# EAGLE board Dragino Pan.v2.0.1 (EAGLE 7.5.0) (continued)
## Tracks (layer width: path | path; a pad name or v marks a point on that pad's centre or on a via) (continued)
  pour Top (rank 2): 18.36,26.55 23.83,30.23 30.23,30.31 30.23,52.79 56.39,52.92 56.39,14.5 70.61,14.5 70.61,110.83 44.2,110.83 44.2,121.24 35.81,121.24 35.81,152.99 53.09,152.99 53.09,159.09 -0.76,159.09 -0.38,26.63
  pour Bottom (rank 2): -0.38,26.63 18.36,26.55 23.83,30.23 30.23,30.31 30.23,52.79 56.39,52.92 56.39,14.5 70.61,14.5 70.61,110.83 44.2,110.83 44.2,121.24 35.81,121.24 35.81,152.99 53.09,152.99 53.09,159.09 -0.76,159.09
  pour Top (isolate 0.406, no thermals): 6.1,35.01 18.8,35.01 18.8,30.69 12.32,30.69 12.32,32.34 6.22,32.34
  pour Top (isolate 0.254, no thermals): 63.63,25.23 69.6,25.23 69.6,20.66 63.88,20.66 63.88,21.67 58.67,21.67 58.67,24.47 63.63,24.47
GPIO1  (via drill 0.3)
  Top 0.254: R28.1 58.17,39.28 58.17,57.23 v56.39,59.01 | v24.51,97.75 24.51,99.11 U5.38
  Bottom 0.254: v56.39,59.01 47.12,68.28 39.5,68.28 39.12,68.66 39.12,69.43 39.37,69.68 39.37,70.44 34.54,75.27 34.04,75.27 26.03,83.27 26.03,86.06 26.54,86.57 26.54,95.72 v24.51,97.75
GPIO6  (via drill 0.3)
  Top 0.203: v28.32,82.38 28.32,81.24 29.97,79.59 36.07,79.59 37.34,78.32 42.8,78.32 43.94,77.17 43.94,75.68 U5.1
  Bottom 0.203: R36.2 27.94,108.67 28.57,108.03 28.57,82.63 v28.32,82.38
GPIO7  (via drill 0.3)
  Top 0.203: v29.08,81.62 29.08,81.11 30.23,79.97 36.32,79.97 37.59,78.7 45.42,78.7 U5.58
  Bottom 0.203: v29.08,81.62 29.08,109.18 28.57,109.69 R37.2
GPIO8  (via drill 0.3)
  Top 0.203: U5.3 40.29,76.25 38.61,77.94 37.08,77.94 35.81,79.2 29.72,79.2 27.94,80.98 27.94,81.62 27.56,82 27.56,83.14 v27.69,83.27
  Bottom 0.203: R10.2 27.81,107.65 28.07,107.4 28.07,83.65 v27.69,83.27
GPIO14  (via drill 0.3)
  Top 0.203: U5.40 28.29,102.61 27.18,103.72 23.24,103.72 v22.73,103.21
  Bottom 0.203: v22.73,103.21 R35.2
GPIO15  (via drill 0.3)
  Top 0.203: U5.41 30.29,103.02 29.21,104.1 22.86,104.1 v22.73,104.22
  Bottom 0.203: v22.73,104.22 R34.2
GPIO16  (via drill 0.3)
  Top 0.203: U5.42 32.29,103.18 30.48,104.99 22.99,104.99 v22.73,105.24
  Bottom 0.203: v22.73,105.24 R39.1
GPIO18  (via drill 0.3)
  Top 0.203: v5.46,86.19 6.65,86.19 U5.24
  Top 0.254: ROUTER.10 15.34,64.12 12.83,66.63 11.43,66.63 10.54,65.74 8.76,65.74 v7.24,67.27
  Bottom 0.254: v7.24,67.27 7.24,68.28 6.22,69.3 6.22,79.2 5.97,79.46 5.59,79.46 5.21,79.84 5.21,80.86 5.71,81.36 5.71,85.94 v5.46,86.19
GPIO19  (via drill 0.3)
  Top 0.203: v6.22,92.29 6.74,92.29 U5.27
  Bottom 0.254: ROUTER.6 10.26,67.55 7.75,70.06 7.75,81.62 6.73,82.63 6.73,91.78 v6.22,92.29
GPIO20  (via drill 0.3, 0.33)
  Top 0.203: v5.97,88.35 6.77,88.35 U5.25
  Top 0.254: v2.92,155.41 2.41,154.9 2.41,154.13 1.27,152.99 1.27,106.76 3.56,104.48 v3.56,104.22
  Bottom 0.254: v2.92,155.41 2.92,154.52 9.4,148.04 9.4,137.5 11.18,135.72 12.53,135.72 BEE-CON-1.5 | v3.56,104.22 3.56,90.76 v5.97,88.35 6.22,88.09 6.22,82.38 7.24,81.36 7.24,69.81 9.78,67.27 9.78,64.98 9.02,64.22 9.02,62.16 ROUTER.5
GPIO21  (via drill 0.3)
  Top 0.203: v8.25,94.19 6.93,94.19 U5.28
  Bottom 0.254: ROUTER.8 12.8,65.52 12.06,66.25 12.06,68.03 9.27,70.82 9.27,93.17 v8.25,94.19
GPIO22  (via drill 0.3)
  Top 0.203: v7.75,84.28 6.84,84.28 U5.23
  Bottom 0.254: ROUTER.7 12.7,60.92 11.43,62.19 11.43,64.6 10.79,65.23 10.79,67.78 8.25,70.31 8.25,82 7.37,82.89 7.37,83.9 v7.75,84.28
GPIO23  (via drill 0.3)
  Top 0.203: U5.26 7.67,90.33 v7.75,90.25
  Top 0.254: ROUTER.9 15.34,60.95 14.1,62.19 14.1,64.6 13.08,65.62 v11.56,65.62
  Bottom 0.254: v11.56,65.62 11.56,67.78 8.76,70.57 8.76,84.54 8.13,85.17 7.62,85.17 7.24,85.56 7.24,89.75 v7.75,90.25
GPIO24  (via drill 0.3)
  Top 0.203: v5.97,80.35 6.77,80.35 U5.21
  Top 0.254: ROUTER.12 17.88,64.12 14.6,67.39 v8.38,67.39
  Bottom 0.254: v8.38,67.39 8.38,67.9 6.73,69.55 6.73,79.59 v5.97,80.35
GPIO26  (via drill 0.3)
  Top 0.254: U5.5 36.29,77.33 35.31,78.32 29.21,78.32 27.05,80.47 27.05,81.11 26.42,81.75 26.42,85.05 v26.8,85.43
  Bottom 0.254: v26.8,85.43 26.92,85.43 27.05,85.56 27.05,105.19 26.62,105.62 R40.1
GPIO27  (via drill 0.3)
  Top 0.203: v27.18,84.41 27.18,84.03 26.92,83.78 26.92,82 27.56,81.36 27.56,80.73 29.46,78.82 35.56,78.82 36.83,77.55 37.72,77.55 38.35,76.92 38.35,75.4 U5.4 | v27.05,106.51 23.88,109.69 v23.88,116.67 | v12.32,116.8 12.37,116.85 R30.2
  Bottom 0.203: v27.18,84.41 27.56,84.79 27.56,106 v27.05,106.51 26.92,106.64 R11.1 | v23.88,116.67 23.75,116.8 v12.32,116.8
JUMPSTART  (via drill 0.3)
  Top 0.203: v48.77,77.17 48.77,78.19 47.24,79.71 46.41,79.71 U5.57
  Top 0.254: v49.4,10.62 49.38,10.64 C14.1 49.53,12.35 49.53,13.04 51.18,14.69 51.18,14.82 56.64,20.28 56.64,36.15 57.66,37.17 57.66,47.51 | U5.57 45.61,80.33 | v56.13,60.41 55.63,59.9 55.63,58.5 56.13,58 56.64,58 57.66,56.98 57.66,47.51 | R42.2 57.66,47.51
  Bottom 0.254: SW1.1 49.76,10.27 v49.4,10.62 | v48.77,77.17 49.02,76.92 49.02,67.14 55.75,60.41 v56.13,60.41
LAN_LED  (via drill 0.3)
  Top 0.254: R19.1 34.53,153.12 4.44,153.12 2.79,151.47 2.79,108.03 4.83,106 v14.22,106 | v26.29,100.16 U5.39
  Bottom 0.254: v26.29,100.16 23.24,100.16 22.61,100.8 22.61,101.18 21.84,101.94 20.95,101.94 17.91,104.99 15.87,104.99 14.86,106 v14.22,106
LED_SYS  (via drill 0.3)
  Top 0.254: SYS.A 29.04,158.58 8.38,158.58 1.78,151.98 1.78,107.53 4.32,104.99 13.08,104.99 14.1,103.97 v14.22,103.97 | v19.18,101.56 19.3,101.43 19.3,97.62 19.94,96.98 35.43,96.98 36.07,97.62 36.07,99.11 U5.44
  Bottom 0.254: v14.22,103.97 17.4,103.97 19.18,102.19 v19.18,101.56
N$1  (via drill 0.3)
  Top 0.203: C1.1 R2.1 47.08,57.74 v47.08,58.7 | v45.16,58.7 45.16,57.78 R1.1
  Bottom 0.203: v45.16,58.7 v47.08,58.7
N$2
  Top 0.254: U2.1 10.54,39.33 L6.P$1 C17.2
  pour Top (isolate 0.254, no thermals): 10.16,35.77 11.43,35.77 11.43,41.1 10.16,41.1
N$3  (via drill 0.3)
  Top 0.203: C2.1 R4.1 v53.05,58.7 | R3.1 50.91,57.78 v50.91,58.7
  Bottom 0.203: v50.91,58.7 v53.05,58.7
N$4  (via drill 0.3)
  Top 0.203: C3.1 R5.1 35.26,58.43 v35.05,58.63 | v36.96,58.63 36.96,57.86 R6.1
  Bottom 0.203: v35.05,58.63 v36.96,58.63
N$5  (via drill 0.3)
  Top 0.203: v42.92,58.7 42.95,58.7 R8.1 | v41.16,58.7 41.16,57.8 R7.1 C4.1
  Bottom 0.203: v41.16,58.7 v42.92,58.7
N$6
  Top 0.203: R14.2 48.69,156.58 PWR.K
N$7
  Bottom 0.254: 39.81,82.89 38.73,82.89 37.85,82 37.85,78.32 37.08,77.55 R23.1
  Bottom 0.305: U3.41 39.81,82.89
N$8
  Bottom 0.305: U3.27 45.82,77 C20.1
N$9
  Top 0.254: R18.2 C57.1
N$10
  Top 0.254: T1.18 49.08,46.26 49.53,45.8 50.16,45.8 50.42,45.55 R9.2
N$11
  Bottom 0.203: R35.1 20.57,103.21 18.29,105.49 16.13,105.49 14.22,107.4 12.45,107.4 11.94,107.91 10.03,107.91 9.02,108.92 6.48,108.92 5.33,110.07 5.33,112.35 ROUTER2.2
N$12
  Top 0.406: C7.1 R9.1
N$13
  Top 0.61: U2.6 8,29.78 8.25,29.52 C57.2
N$14
  Top 0.254: U4.5 58.93,17.48
  Top 0.61: R55.1 58.93,17.48 R56.2
N$15  (via drill 0.3)
  Top 0.254: U4.3 R57.1 59.51,27.95 59.13,28.33 v59.13,31 | v59.13,40.85 Q1.1
  Bottom 0.254: v59.13,31 v59.13,40.85
N$16
  Bottom 0.254: R21.2 36.58,80.6 36.83,80.86 36.83,82.63 38.1,83.9 U3.43
N$17
  Top 0.254: T1.13 39.08,46.48 39.75,45.8 40.39,45.8 40.64,45.55 40.64,44.88 R12.2
N$18
  Top 0.406: C10.1 R12.1
N$19
  Top 0.254: U4.7 R22.1
N$20
  Top 0.254: Q1.3 60.64,37.66 R24.2 60.96,37.35 R28.2
N$21
  Top 0.254: U4.6 C58.2
N$22  (via drill 0.3)
  Top 0.254: U14.5 59.56,76.79 53.47,70.7 43.43,70.7 v42.54,71.59
  Bottom 0.254: R20.2 42.29,74.81 C15.1 42.29,74.71 42.29,74 42.54,73.74 v42.54,71.59
N$23
  Top 0.254: R19.2 38.99,156.58 LAN.K
N$24
  Bottom 0.305: R27.2 46.66,89.03 46.32,88.69 U3.11
N$25
  Top 0.254: R46.2 U2.3
N$26
  Top 0.254: U2.7 R17.1
N$27
  Top 0.254: C17.1 U2.2
N$28
  Top 0.61: C58.1 60.2,16.01 R29.1
N$29
  Bottom 0.305: U3.9 45.32,89.6 46.74,91.02 47.12,91.02 47.37,91.27 R15.2 C16.1
N$30
  Bottom 0.254: U3.7 44.32,90 45.34,91.02
  Bottom 0.305: 45.46,91.71 R16.2 45.34,91.02
N$31
  Top 0.254: WLAN.K 18.47,156.71 R31.2
N$32
  Top 0.254: R32.2 28.5,156.58 SYS.K
N$33
  Bottom 0.203: R39.2 19.81,105.24 18.8,106.26 16.64,106.26 14.6,108.29 12.83,108.29 11.81,109.3 8.07,109.3 ROUTER2.1
N$34
  Top 0.254: C41.2 61.47,30.95 61.59,31.07 62.61,31.07 62.74,31.2
  Top 0.406: U4.1 62.74,31.2 62.74,32.43 L2.P$1
  pour Top (isolate 0.254, no thermals): 62.48,25.1 63.12,25.1 63.12,28.79 63.12,29.17 63.88,29.17 63.88,35.52 61.72,35.52 61.72,29.55 62.48,29.55
N$35
  Bottom 0.203: ROUTER2.5 13.15,109.3 14.86,109.3 17.02,107.14 24.13,107.14 24.64,106.64 R11.2
N$36
  Top 0.254: T4.2 R30.1
N$39
  Bottom 0.203: R10.1 17.27,107.65 15.24,109.69 13.46,109.69 12.83,110.32 12.83,112.16 ROUTER2.6
N$43
  Bottom 0.203: ROUTER2.3 10.22,109.69 12.06,109.69 12.95,108.8 14.73,108.8 16.76,106.76 23.88,106.76 24.26,106.38 24.26,105.88 24.51,105.62 R40.2
N$49
  Top 0.406: R13.1 6.63,30.74 U2.5
  Top 0.61: R41.2 R13.1
N$50  (via drill 0.3)
  Top 0.203: v10.29,108.67 10.29,112.16 ROUTER2.4
  Bottom 0.203: R34.1 20.19,104.22 18.54,105.88 16.38,105.88 14.48,107.78 12.7,107.78 11.68,108.8 10.41,108.8 v10.29,108.67
N$53
  Top 0.305: D25.C 9.5,24.59 9.93,25.03 12.22,25.03 12.65,24.59 12.65,24.67 L3.P$2
  Top 0.813: 12.32,24.59 L3.P$2
  Top 1.422: L3.P$2 17.4,25 17.4,22.31 19.81,22.31 F2.P$1
N$54
  Bottom 0.203: R36.1 16.89,108.67 15.37,110.19 15.37,112.16 ROUTER2.8
N$55
  Top 0.254: U4.2 C41.1
N$56
  Bottom 0.203: R37.1 18.67,109.69 17.91,110.45 17.91,112.16 ROUTER2.10
P0_R_N
  Top 0.203: X11.2-3 32.61,15.2 32.36,15.45 32.36,16.12 32.99,16.75 39.85,16.75 42.27,19.17 42.27,28.56 44.42,30.72 47.12,30.72 | 47.12,30.72 49.75,30.72 50.9,31.87 50.9,37.64 50.13,38.41 47.08,38.41 46.33,39.17 46.33,46.2 T1.17 | 47.12,30.72 47.12,30.07 P1.3
P0_R_P
  Top 0.203: 50.44,36.91 50.44,37.45 49.94,37.95 46.89,37.95 45.87,38.98 45.87,46.16 T1.16 | 50.44,36.91 50.44,32.06 49.56,31.17 44.23,31.17 41.81,28.75 41.81,19.36 39.66,17.2 32.8,17.2 31.9,16.31 31.9,14.21 31.62,13.93 29.72,13.93 29.46,13.67 X11.2-6 | P1.1 50.37,36.84 50.44,36.91
P0_RX_N
  Top 0.203: T1.4 47.08,54.81 46.3,55.58 46.3,56.73 | 46.3,56.73 46.3,60.28 | 46.3,60.28 46.3,61.89 45.04,63.15 43.65,63.15 40.47,66.33 30.06,66.33 23.45,72.93 20.02,72.93 19.38,73.58 19.38,74.42 U5.13 | R2.2 46.32,56.74 46.3,56.73 | D22.P$2 46.35,60.33 46.3,60.28
P0_RX_P
  Top 0.203: T1.5 45.08,54.77 45.9,55.58 45.9,56.73 | 45.9,56.73 45.9,60.41 | 45.9,60.41 45.9,61.72 44.87,62.75 43.48,62.75 40.3,65.92 29.89,65.92 23.28,72.52 19.85,72.52 18.97,73.41 18.97,73.79 18.97,74.12 18.97,74.65 U5.14 | R1.2 45.89,56.74 45.9,56.73 | D22.P$1 45.81,60.33 45.9,60.41
P0_T_N
  Top 0.203: X11.2-7 28.19,14.18 27.94,13.93 26.03,13.93 25.42,13.32 25.42,11.29 26.07,10.65 35.78,10.65 36.68,11.55 36.68,13.2 37.31,13.83 42.26,13.83 43.41,14.97 43.41,20.06 44.01,20.66 47.37,20.66 | T1.20 53.08,46.58 52.3,45.8 52.3,29.58 51.03,28.31 51.03,21.81 49.88,20.66 47.37,20.66 | P2.3 47.37,19.73 47.37,20.66
P0_T_P
  Top 0.203: X11.2-8 26.92,12.66 26.16,12.66 25.88,12.38 25.88,11.48 26.26,11.11 35.59,11.11 36.22,11.74 36.22,13.39 37.12,14.28 42.07,14.28 42.95,15.17 42.95,20.25 43.82,21.11 49.69,21.11 50.57,22 50.57,26.5 | T1.19 51.08,46.57 51.84,45.8 51.84,29.77 50.57,28.5 50.57,26.5 | P2.1 47.43,26.5 50.57,26.5
P0_TX_N
  Top 0.203: T1.1 53.08,55.16 52.27,55.96 52.27,56.85 | 52.27,56.85 52.27,60.03 | 52.27,60.03 52.27,61.38 51.27,62.39 48.34,62.39 45.55,65.19 44.28,65.19 41.23,68.23 30.82,68.23 25.23,73.82 23.83,73.82 23.57,74.08 23.57,74.62 U5.11 | R4.2 52.29,56.87 52.27,56.85 | D15.P$2 52.36,59.95 52.27,60.03
P0_TX_P
  Top 0.203: T1.2 51.08,55.18 51.87,55.96 51.87,56.73 | 51.87,56.73 51.87,60.03 | 51.87,60.03 51.87,61.21 51.1,61.98 48.17,61.98 45.38,64.78 44.11,64.78 41.06,67.83 30.65,67.83 25.06,73.41 23.66,73.41 23.16,73.91 23.16,74.51 22.34,75.33 U5.12 | R3.2 51.73,56.86 51.87,56.73 | D15.P$1 51.78,59.95 51.87,60.03
P4_R_N
  Top 0.203: X11.1-3 18.97,15.2 18.47,15.7 18.47,16.88 19.6,18.02 29.94,18.02 31.09,19.17 31.09,30.09 31.97,30.97 37.34,30.97 | 37.34,30.97 40.23,30.97 41,31.74 41,38.02 40.23,38.79 36.92,38.79 36.42,39.3 36.42,46.3 T1.12 | P3.3 37.34,30.97
P4_R_P
  Top 0.203: X11.1-6 15.49,13.67 15.75,13.93 17.53,13.93 18.01,14.41 18.01,17.07 19.41,18.47 29.75,18.47 30.63,19.36 30.63,30.28 31.78,31.43 40.04,31.43 40.54,31.93 40.54,36.89 | T1.11 35.97,46.06 35.97,39.1 36.73,38.34 40.04,38.34 40.54,37.84 40.54,36.89 | 40.54,36.89 40.49,36.84 P3.1
P4_RX_N
  Top 0.203: T1.9 37.08,55.03 36.27,55.84 36.27,56.85 | 36.27,56.85 36.27,59.35 35.89,59.73 35.89,60.28 | 35.89,60.28 35.89,61.38 35.01,62.26 28.02,62.26 21.42,68.87 12.91,68.87 9.35,72.43 9.35,74 10.29,74.94 U5.18 | D24.P$2 35.94,60.33 35.89,60.28 | R6.2 36.28,56.86 36.27,56.85
P4_RX_P
  Top 0.203: T1.10 35.08,55.05 35.86,55.84 35.86,56.73 | 35.86,56.73 35.86,59.18 35.48,59.56 35.48,60.28 | 35.48,60.28 35.48,61.21 34.84,61.86 27.85,61.86 21.25,68.46 12.74,68.46 8.94,72.26 8.94,74.68 U5.19 8.35,75.27 8.51,75.27 8.51,75.56 | D24.P$1 35.44,60.33 35.48,60.28 | R5.2 35.73,56.86 35.86,56.73
P4_T_N
  Top 0.203: X11.1-7 14.22,14.44 13.84,14.05 12.57,14.05 11.45,12.94 11.45,11.29 12.48,10.27 23.21,10.27 24.49,11.55 24.49,13.58 27.65,16.75 30.96,16.75 32.61,18.4 32.61,19.8 33.5,20.68 37.34,20.68 | T1.15 43.06,46.95 42.29,46.19 42.29,30.06 41.02,28.79 41.02,21.67 40.03,20.68 37.34,20.68 | P4.3 37.34,20.68
P4_T_P
  Top 0.203: X11.1-8 12.3,12.67 11.91,12.28 11.91,11.48 12.67,10.73 23.02,10.73 24.03,11.74 24.03,13.77 27.46,17.2 30.77,17.2 32.16,18.59 32.16,19.99 33.31,21.14 39.78,21.14 40.54,21.9 40.54,26.63 | T1.14 41.81,46.22 41.81,30.28 40.54,29.01 40.54,26.63 | P4.1 40.53,26.62 40.54,26.63
P4_TX_N
  Top 0.203: T1.6 43.08,55 42.24,55.84 42.24,56.85 | 42.24,56.85 42.24,60.28 | 42.24,60.28 42.24,61.38 40.47,63.15 37.42,63.15 36.41,64.17 29.55,64.17 22.44,71.28 15.2,71.28 13.41,73.07 13.41,74.46 U5.16 | D23.P$2 42.29,60.33 42.24,60.28 | R8.2 42.25,56.86 42.24,56.85
P4_TX_P
  Top 0.203: T1.7 41.08,55.08 41.83,55.84 41.83,56.98 | 41.83,56.98 41.83,60.28 | 41.83,60.28 41.83,61.21 40.3,62.75 37.25,62.75 36.24,63.76 29.38,63.76 22.27,70.87 15.03,70.87 13,72.9 13,74.62 U5.17 | D23.P$1 41.79,60.33 41.83,60.28 | R7.2 41.72,56.86 41.83,56.98
PE  (via drill 0.25 pad 1.27, 0.25 pad 1.52, 0.81)
  Top 0.406: v37.34,22.94 P4.2 36.96,23.14 36.96,23.33
  Top 1.27: v48.01,6.81 48.01,16.09 48.89,16.97 50.55,16.97 55.12,21.55 v55.12,22.94 55.15,22.97 C11.2 | v32.26,27.52 32.26,23.71 32.64,23.33 36.96,23.33 | C10.2 38.63,40.47 v40.64,40.47 | C7.2 48.46,40.47 v50.67,40.47 | 37.1,33.24 v37.21,33.36 P3.2 | P1.2 v47.37,33.36 | v47.37,22.94 47.37,23.08 P2.2
  Top 1.422: C12.2 32.09,33.36 v37.21,33.36
  Bottom 1.27: X11.P$3 X11.P$2 38.56,1.81 | v40.64,40.47 40.64,33.74 40.26,33.36 | v50.67,40.47 50.67,34.88 49.15,33.36 v47.37,33.36 | v32.26,27.52 24.38,27.52 X11.P$1 | v37.21,33.36 40.26,33.36 | 40.26,33.36 v47.37,33.36 | v37.34,22.94 v47.37,22.94 | v55.12,22.94 v47.37,22.94 | v47.37,33.36 v47.37,22.94
  Bottom 1.422: 38.56,1.81 43.26,1.81 44.58,3.13 44.58,5.29 46.1,6.81 v48.01,6.81
POE_PASSTHROUGH  (via drill 0.58)
  Top 1.016: v24,8.85 v24,5.55
  Bottom 1.016: v24,5.55 29.72,5.55 31.75,3.51 38.61,3.51 40.64,5.55 40.64,5.57 JP2.2 | v24,8.85 18.67,8.85 18.03,9.48 X11.1-4
POE_VIN  (via drill 0.25 pad 1.27)
  Top 1.016: v9.4,12.4 D4.A
  Bottom 0.813: X11.2-4 31.75,12.92 31.75,13.8 30.73,14.82 X11.2-5
  Bottom 1.016: JP2.1 36.43,10.6 35.18,9.36 32,9.36 | 32,9.36 30.48,9.36 28.19,7.07 16.13,7.07 12.83,10.37 10.92,10.37 9.4,11.89 v9.4,12.4 | X11.2-4 32,9.36
SD_CLK
  Bottom 0.254: U3.34 42.32,76.77 R20.1
SD_CMD  (via drill 0.3)
  Top 0.203: v41.53,70.44 41.53,70.31 42.54,69.3 54.1,69.3 61.09,76.28 61.09,83.14 61.72,83.78 61.72,85.22 U14.3
  Bottom 0.203: U3.36 41.32,70.65 v41.53,70.44
SD_DAT0  (via drill 0.3)
  Top 0.203: v47.12,71.84 52.32,71.84 57.28,76.79 57.28,85.17 U14.7
  Bottom 0.203: U3.30 44.32,74.76 47.12,71.97 v47.12,71.84
SD_DAT1  (via drill 0.3)
  Top 0.203: v48.26,72.6 52.45,72.6 56.9,77.05 56.9,83.65 56.26,84.28 U14.8
  Bottom 0.203: U3.29 44.82,74.9 47.12,72.6 v48.26,72.6
SD_DAT2  (via drill 0.3)
  Top 0.203: U14.1 63.96,84.49 62.99,83.52 62.74,83.52 61.85,82.63 61.85,75.78 54.61,68.54 42.04,68.54 41.53,69.05 40.89,69.05 40.77,69.17 v40,69.17
  Bottom 0.203: v40,69.17 39.88,69.3 39.88,70.31 40.26,70.7 40.26,71.33 40.51,71.59 40.51,76.03 38.61,77.94 38.61,81.36 39.12,81.87 39.79,81.87 U3.39
SD_DAT3  (via drill 0.3)
  Top 0.203: U14.2 62.86,84.28 61.47,82.89 61.47,76.03 54.36,68.92 42.29,68.92 41.66,69.55 41.15,69.55 v40.64,70.06
  Bottom 0.203: v40.64,70.06 40.64,71.08 40.89,71.33 40.89,78.7 40.77,78.82 40.77,81.11 40.51,81.36 39.85,81.36 U3.38
UART_RX  (via drill 0.3)
  Top 0.203: v10.41,78.32 11.56,78.32 17.53,84.28 17.53,96.73 18.29,97.49 U5.35 | U6.3 17.14,122.38 17.78,121.75 17.78,110.19 16.76,109.18 16.76,102.19 18.29,100.67 U5.35 | U5.35
  Top 0.254: U6.3
  Bottom 0.203: ROUTER.13 19.93,60.92 19.18,61.68 19.18,64.22 18.16,65.23 16.76,65.23 9.78,72.22 9.78,77.68 v10.41,78.32
UART_TX  (via drill 0.3)
  Top 0.203: v11.3,79.08 11.68,79.08 17.14,84.54 17.14,98.48 U5.34 16.29,109.27 15.37,110.19 15.37,122.51 15.75,122.89 U6.2
  Top 0.254: U6.2
  Bottom 0.203: ROUTER.14 20.42,63.74 18.41,65.74 16.89,65.74 10.29,72.35 10.29,77.3 10.54,77.55 10.92,77.55 11.18,77.81 11.18,78.95 v11.3,79.08
USB2_D1_N
  Bottom 0.203: R44.2 28.79,111.84 25.44,115.2 20.88,115.2 20.32,114.64 20.32,112.09 ROUTER2.11
USB2_D1_P
  Bottom 0.203: R38.1 28.36,112.86 25.61,115.6 20.4,115.6 19.3,114.51 19.3,113.62 ROUTER2.12
USB2_D_N
  Bottom 0.203: U3.47 38.32,85.9 37.49,86.73 37.49,110.61 36.15,111.95 32.05,111.95 R44.1
USB2_D_P
  Bottom 0.203: U3.48 38.47,86.4 37.95,86.92 37.95,110.8 36.34,112.4 32.62,112.4 32.17,112.86 R38.2
USB3_D_N
  Bottom 0.203: U3.2 41.82,90.44 39.55,92.71 39.55,111.63 36.24,114.94 34.21,114.94 30.91,118.24 30.91,127.89 28.62,130.18 13.44,130.18 BEE-CON-1.8
USB3_D_P
  Bottom 0.203: U3.3 42.32,90.51 39.95,92.88 39.95,111.8 36.41,115.35 34.37,115.35 31.32,118.41 31.32,128.06 28.79,130.59 13.66,130.59 BEE-CON-1.7
USB4_D_N
  Bottom 0.203: U3.4 42.82,95.89 47.03,100.11 52.32,100.11 | 52.32,100.11 58.76,100.11 60.56,98.3 USB1.2 | D2.P$1 52.32,100.11
USB4_D_P
  Bottom 0.203: U3.5 43.32,95.82 47.2,99.7 52.32,99.7 | 52.32,99.7 58.59,99.7 59.44,98.86 59.44,98.13 58.72,97.41 USB1.3 | D1.P$1 52.32,99.7
USB_N  (via drill 0.3)
  Top 0.203: v51.31,85.4 51.31,85.15 54.7,85.15 55.6,84.25 55.6,79.24 51.87,75.5 50.05,75.5 47.71,73.16 33.1,73.16 31.96,72.02 29.89,72.02 29.13,72.77 29.13,74.49 U5.9 28.29,75.22
  Bottom 0.203: v51.31,85.4 51.31,85.15 50.67,85.15 49.92,84.4 U3.17
USB_P  (via drill 0.3)
  Top 0.203: v51.31,84.44 51.31,84.69 54.52,84.69 55.14,84.06 55.14,79.43 51.62,75.9 49.88,75.9 47.54,73.57 32.93,73.57 31.79,72.42 30.06,72.42 29.54,72.94 29.54,74.59 U5.8 30.29,74.87
  Bottom 0.203: v51.31,84.44 51.31,84.64 51.33,84.67 51.82,84.67 52.07,84.92 52.07,85.68 51.56,86.19 50.8,86.19 49.51,84.9 U3.16
VCC1.8  (via drill 0.33)
  Top 0.254: v52.2,80.35 v49.66,80.35
  Top 0.305: v48.51,87.71 48.51,81.49 v49.66,80.35
  Top 0.406: v48.51,87.71 48.51,95.72 v48.13,96.1
  Bottom 0.203: U3.19 49.91,83.4 50.42,83.4 50.55,83.27 51.82,83.27 52.2,82.89 52.2,82.13
  Bottom 0.254: v49.66,80.35 50.22,80.35 C31.1 | 52.2,82.13 v52.2,80.35
  Bottom 0.305: U3.12 46.82,87.71 v48.51,87.71 49.4,87.71 C33.1 | v52.2,80.35 52.2,80.42 C32.1 | v49.66,80.35 49.4,80.6 49.4,81.11 49.11,81.4 U3.23
  Bottom 0.406: R16.1 45.34,93.68 47.75,96.1 v48.13,96.1
VCC3.3
  Bottom 0.203: U3.22 49.25,81.9 49.78,81.36 51.05,81.36 51.44,80.98 51.44,80.55 C27.1
  Bottom 0.254: 50.67,86.83 49.25,85.4 U3.15 | 44.32,90.89 43.82,90.39 U3.6 43.82,86.32 | U3.1 40.6,87.9 C30.1 | 35.94,81.62 C26.1 36.07,81.62 36.32,81.87 36.32,83.02 37.72,84.41 39.81,84.41 U3.44 | C24.1 37.08,79.59 37.34,79.84 37.34,82.38 38.35,83.4 U3.42
  Bottom 0.305: U3.42 41.4,83.4 | C24.1 C25.1 | C28.1 50.67,86.83 | 44.32,90.89 C29.1 | C23.1 47.57,90.38 46.99,90.38 45.82,89.21 U3.10 45.82,86.73 45.85,86.7 | U3.15 47.34,85.4 47.12,85.17 46.35,85.17 | 45.85,85.68 45.85,86.19 | U3.44 41.39,84.4 41.4,84.41 | 45.34,81.87 45.37,81.9 45.59,81.9 U3.22 | U3.1 41.32,86.65 41.4,86.57
  Bottom 0.406: 45.85,86.7 45.85,86.19 45.85,85.43 46.23,85.05 46.23,84.92 45.97,84.67 45.97,82.28 45.59,81.9 | 46.35,85.17 45.85,85.68 | 43.82,86.32 43.82,85.68 41.4,85.68 | 47.57,90.38 47.95,90.38 R27.1
  Bottom 0.813: 45.34,81.87 42.54,81.87 41.4,83.02 41.4,83.4 41.4,84.41 41.4,85.68 41.4,86.57
VDD  (via drill 0.3, 0.58)
  Top 0.254: R46.1 v8,41.77 | R57.2 v60.2,29.85
  Top 0.61: U4.8 v62.74,18.5 62.99,18.25 65.34,18.25 C43.1 67.79,18.31 C56.1 | C19.1 11.41,28.22 10.54,29.09 U2.8
  Top 1.27: C19.1 C53.1 19.77,28.22 19.81,28.18 | 19.81,28.18 19.81,30.56 21.01,31.76 21.01,31.83 | 19.81,28.18 F2.P$2 | ROUTER.15 22.96,59.31 21.13,57.49 21.13,31.96 21.01,31.83 | D33.C 21.15,32.73 21.01,32.59 21.01,31.83
  Bottom 0.254: v8,41.77 22.2,41.77 23.62,40.34 23.62,32.88 D33.C | v60.2,29.85 57.15,29.85 56.59,29.29 56.59,19.01 56.08,18.5
  Bottom 1.27: v62.74,18.5 56.08,18.5 55.14,18.5 53.97,17.33 35.66,17.33 34.34,18.65 34.34,31 32.6,32.73 D33.C
  pour Top (isolate 0.406, no thermals): 10.16,31.45 11.43,31.45 11.43,29.55 19.05,29.55 19.05,26.88 10.16,26.88
  pour Top (isolate 0.254, no thermals): 63.25,21.17 63.25,20.02 68.83,20.02 68.83,17.36 62.36,17.36 62.36,21.17
VIN1
  Top 1.27: D4.C 3.61,12.4 4.57,13.37 4.57,19.87 5.69,20.99 6.64,20.99 V1.P$2
  Top 1.524: D5.C D4.C | V1.P$2 6.68,21.02 6.68,19.13 6.71,19.11 L3.P$1
WLAN_LED  (via drill 0.3)
  Top 0.254: WLAN.A 19.64,158.07 8.64,158.07 2.29,151.72 2.29,107.78 4.57,105.49 13.33,105.49 13.84,104.99 v14.22,104.99 | v22.1,100.16 22.35,99.91 22.35,99.4 U5.37
  Bottom 0.254: v22.1,100.16 22.1,100.92 21.59,101.43 20.7,101.43 17.65,104.48 15.62,104.48 15.11,104.99 v14.22,104.99
XSCI
  Bottom 0.254: X1.1 34.92,85.99 C18.1 36.02,86.06 36.7,86.06 37.37,85.4 U3.46
XSCO
  Bottom 0.254: X1.3 32.6,84.5 33.4,85.3 35.38,85.3 C21.1 36.1,84.9 U3.45

## Text on the board
tPlace: MODEL Pan v2.0 | 3V3 | +5V
tNames: U14
tDocu: USB3+ | USB3-